# Altium schematic sheet schematic1.SchDoc (part 3 of 3)
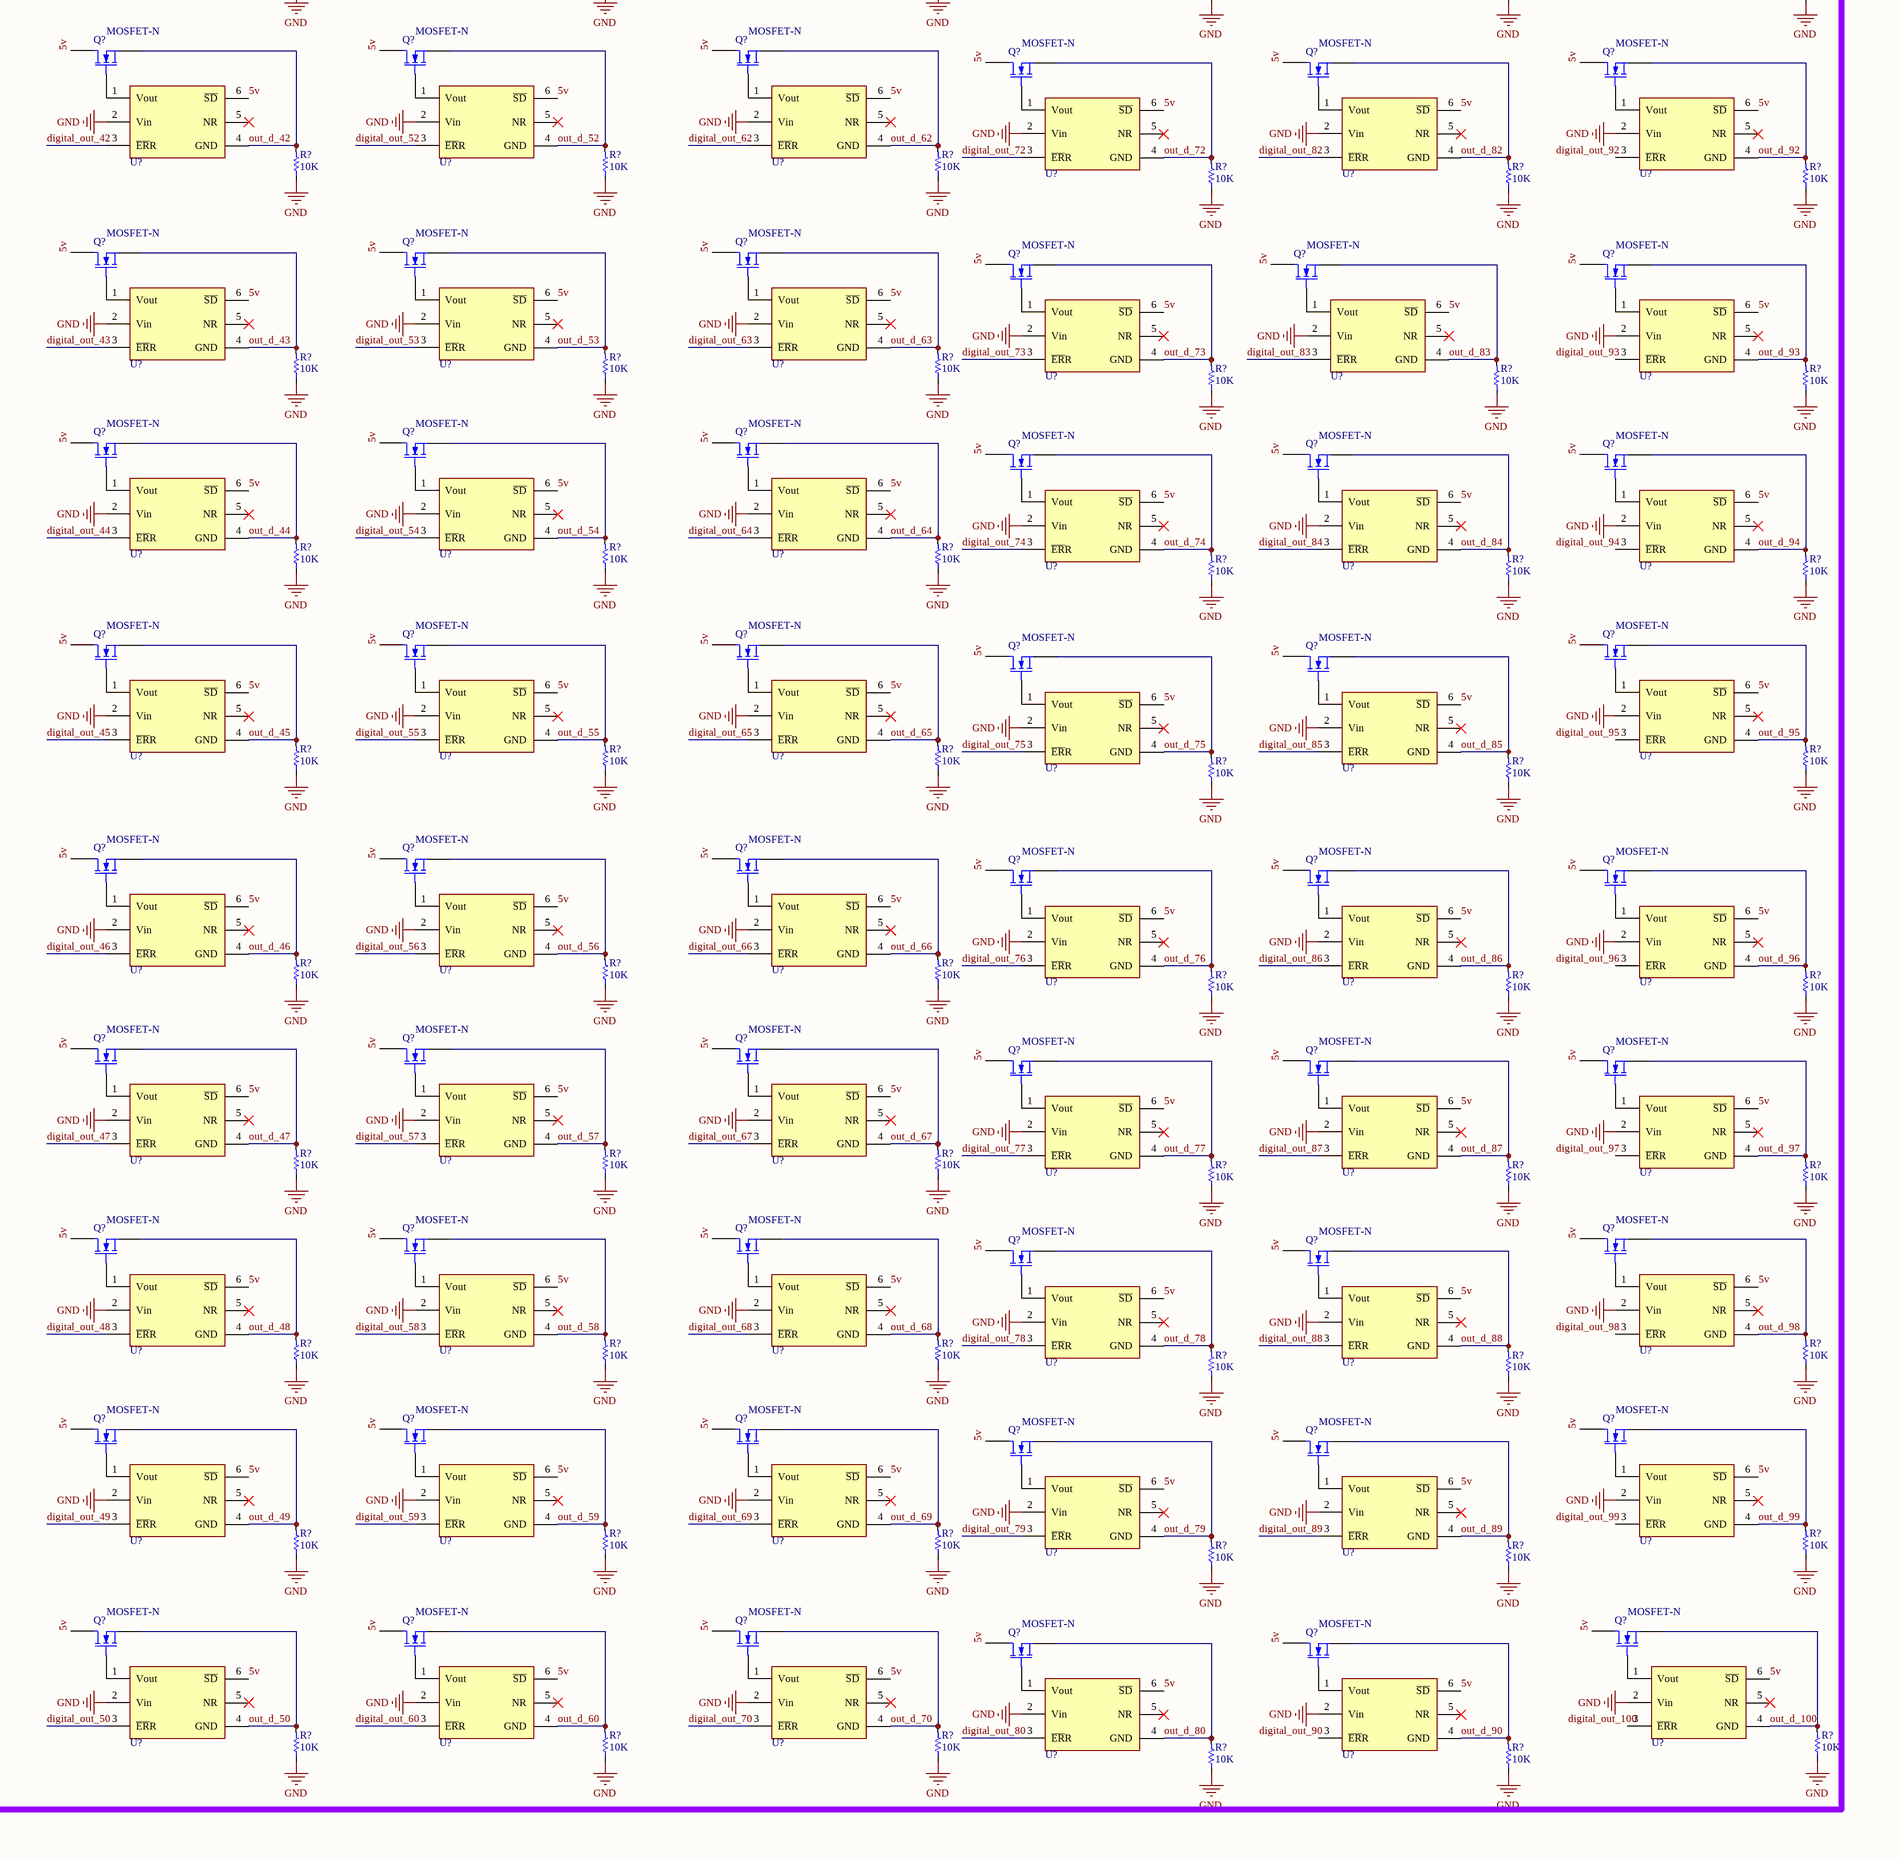
[diagram p9: schematic1.SchDoc, bottom column 4 of 4]

## Nets (continued)
NetQ?#24_2: Q?#24.2(G) U?#62.1(Vout)
NetQ?#25_2: Q?#25.2(G) U?#63.1(Vout)
NetQ?#26_2: Q?#26.2(G) U?#64.1(Vout)
NetQ?#27_2: Q?#27.2(G) U?#65.1(Vout)
NetQ?#28_2: Q?#28.2(G) U?#66.1(Vout)
NetQ?#29_2: Q?#29.2(G) U?#67.1(Vout)
NetQ?#30_2: Q?#30.2(G) U?#68.1(Vout)
NetQ?#31_2: Q?#31.2(G) U?#79.1(Vout)
NetQ?#32_2: Q?#32.2(G) U?#80.1(Vout)
NetQ?#33_2: Q?#33.2(G) U?#81.1(Vout)
NetQ?#34_2: Q?#34.2(G) U?#82.1(Vout)
NetQ?#35_2: Q?#35.2(G) U?#83.1(Vout)
NetQ?#36_2: Q?#36.2(G) U?#84.1(Vout)
NetQ?#37_2: Q?#37.2(G) U?#85.1(Vout)
NetQ?#38_2: Q?#38.2(G) U?#86.1(Vout)
NetQ?#39_2: Q?#39.2(G) U?#87.1(Vout)
NetQ?#40_2: Q?#40.2(G) U?#88.1(Vout)
NetQ?#41_2: Q?#41.2(G) U?#99.1(Vout)
NetQ?#42_2: Q?#42.2(G) U?#100.1(Vout)
NetQ?#43_2: Q?#43.2(G) U?#101.1(Vout)
NetQ?#44_2: Q?#44.2(G) U?#102.1(Vout)
NetQ?#45_2: Q?#45.2(G) U?#103.1(Vout)
NetQ?#46_2: Q?#46.2(G) U?#104.1(Vout)
NetQ?#47_2: Q?#47.2(G) U?#105.1(Vout)
NetQ?#48_2: Q?#48.2(G) U?#106.1(Vout)
NetQ?#49_2: Q?#49.2(G) U?#107.1(Vout)
NetQ?#50_2: Q?#50.2(G) U?#108.1(Vout)
NetQ?#51_2: Q?#51.2(G) U?#119.1(Vout)
NetQ?#52_2: Q?#52.2(G) U?#120.1(Vout)
NetQ?#53_2: Q?#53.2(G) U?#121.1(Vout)
NetQ?#54_2: Q?#54.2(G) U?#122.1(Vout)
NetQ?#55_2: Q?#55.2(G) U?#123.1(Vout)
NetQ?#56_2: Q?#56.2(G) U?#124.1(Vout)
NetQ?#57_2: Q?#57.2(G) U?#125.1(Vout)
NetQ?#58_2: Q?#58.2(G) U?#126.1(Vout)
NetQ?#59_2: Q?#59.2(G) U?#127.1(Vout)
NetQ?#60_2: Q?#60.2(G) U?#128.1(Vout)
NetQ?#61_2: Q?#61.2(G) U?#139.1(Vout)
NetQ?#62_2: Q?#62.2(G) U?#140.1(Vout)
NetQ?#63_2: Q?#63.2(G) U?#141.1(Vout)
NetQ?#64_2: Q?#64.2(G) U?#142.1(Vout)
NetQ?#65_2: Q?#65.2(G) U?#143.1(Vout)
NetQ?#66_2: Q?#66.2(G) U?#144.1(Vout)
NetQ?#67_2: Q?#67.2(G) U?#145.1(Vout)
NetQ?#68_2: Q?#68.2(G) U?#146.1(Vout)
NetQ?#69_2: Q?#69.2(G) U?#147.1(Vout)
NetQ?#70_2: Q?#70.2(G) U?#148.1(Vout)
NetQ?#71_2: Q?#71.2(G) U?#159.1(Vout)
NetQ?#72_2: Q?#72.2(G) U?#160.1(Vout)
NetQ?#73_2: Q?#73.2(G) U?#161.1(Vout)
NetQ?#74_2: Q?#74.2(G) U?#162.1(Vout)
NetQ?#75_2: Q?#75.2(G) U?#163.1(Vout)
NetQ?#76_2: Q?#76.2(G) U?#164.1(Vout)
NetQ?#77_2: Q?#77.2(G) U?#165.1(Vout)
NetQ?#78_2: Q?#78.2(G) U?#166.1(Vout)
NetQ?#79_2: Q?#79.2(G) U?#167.1(Vout)
NetQ?#80_2: Q?#80.2(G) U?#168.1(Vout)
NetQ?#81_2: Q?#81.2(G) U?#179.1(Vout)
NetQ?#82_2: Q?#82.2(G) U?#180.1(Vout)
NetQ?#83_2: Q?#83.2(G) U?#181.1(Vout)
NetQ?#84_2: Q?#84.2(G) U?#182.1(Vout)
NetQ?#85_2: Q?#85.2(G) U?#183.1(Vout)
NetQ?#86_2: Q?#86.2(G) U?#184.1(Vout)
NetQ?#87_2: Q?#87.2(G) U?#185.1(Vout)
NetQ?#88_2: Q?#88.2(G) U?#186.1(Vout)
NetQ?#89_2: Q?#89.2(G) U?#187.1(Vout)
NetQ?#90_2: Q?#90.2(G) U?#188.1(Vout)
NetQ?#91_2: Q?#91.2(G) U?#199.1(Vout)
NetQ?#92_2: Q?#92.2(G) U?#200.1(Vout)
NetQ?#93_2: Q?#93.2(G) U?#201.1(Vout)
NetQ?#94_2: Q?#94.2(G) U?#202.1(Vout)
NetQ?#95_2: Q?#95.2(G) U?#203.1(Vout)
NetQ?#96_2: Q?#96.2(G) U?#204.1(Vout)
NetQ?#97_2: Q?#97.2(G) U?#205.1(Vout)
NetQ?#98_2: Q?#98.2(G) U?#206.1(Vout)
NetQ?#99_2: Q?#99.2(G) U?#207.1(Vout)
NetQ?#100_2: Q?#100.2(G) U?#208.1(Vout)
NetR?#1_1: R?#1.1 R?#3.1 U3.63(PC6)
NetR?#2_1: R?#2.1 R?#4.1 U3.64(PC7)
NetR?#5_1: R?#5.1 R?#10.1 U1.63(PC6)
NetR?#6_1: R?#6.1 R?#12.1 U3.65(PC8(SDIO_D0))
NetR?#7_1: R?#7.1 R?#13.1 U3.67(PA8)
NetR?#8_1: R?#8.1 R?#14.1 U1.64(PC7)
NetR?#9_1: R?#9.1 R?#16.1 U3.66(PC9(SDIO_D1))
NetR?#11_1: R?#11.1 R?#18.1 U3.68(PA9(USART1_TX))
NetR?#15_1: R?#15.1 R?#22.1 U3.69(PA10(USART1_RX))
NetR?#17_1: R?#17.1 R?#24.1 U1.65(PC8(SDIO_D0))
NetR?#19_1: R?#19.1 R?#26.1 U1.67(PA8)
NetR?#20_1: R?#20.1 R?#27.1 U3.70(PA11)
NetR?#21_1: R?#21.1 R?#29.1 U1.66(PC9(SDIO_D1))
NetR?#23_1: R?#23.1 R?#30.1 U1.68(PA9(USART1_TX))
NetR?#25_1: R?#25.1 R?#31.1 U3.71(PA12)
NetR?#28_1: R?#28.1 R?#33.1 U1.69(PA10(USART1_RX))
NetR?#32_1: R?#32.1 R?#35.1 U1.70(PA11)
NetR?#34_1: R?#34.1 R?#36.1 U1.71(PA12)
NetR?#37_1: R?#37.1 R?#39.1 U3.36(PB1)
NetR?#38_1: R?#38.1 R?#40.1 U3.37(PB2/BOOT1)
NetR?#41_1: R?#41.1 R?#43.1 U1.36(PB1)
NetR?#42_1: R?#42.1 R?#44.1 U1.37(PB2/BOOT1)
NetR?#45_1: R?#45.1 R?#47.2 U3.55(PD8(USART3_TX))
NetR?#46_1: R?#46.1 R?#53.1 U3.57(PD10)
NetR?#48_1: R?#48.1 R?#54.1 U3.47(PB10(I2C2_SCL))
NetR?#49_1: R?#49.1 R?#51.2 U3.56(PD9(USART3_RX))
NetR?#50_1: R?#50.1 R?#58.1 U3.58(PD11)
NetR?#52_1: R?#52.1 R?#61.1 U3.48(PB11(I2C2_SDA))
NetR?#55_1: R?#55.1 R?#66.1 U3.59(PD12)
NetR?#56_1: R?#56.1 R?#60.2 U1.55(PD8(USART3_TX))
NetR?#57_1: R?#57.1 R?#69.1 U3.51(PB12(SPI2_NSS))
NetR?#59_1: R?#59.1 R?#72.1 U1.57(PD10)
NetR?#62_1: R?#62.1 R?#74.1 U3.60(PD13)
NetR?#63_1: R?#63.1 R?#75.1 U1.47(PB10(I2C2_SCL))
NetR?#64_1: R?#64.1 R?#68.2 U1.56(PD9(USART3_RX))
NetR?#65_1: R?#65.1 R?#77.1 U3.52(PB13(SPI2_SCK))
NetR?#67_1: R?#67.1 R?#80.1 U1.58(PD11)
NetR?#70_1: R?#70.1 R?#82.1 U3.61(PD14)
NetR?#71_1: R?#71.1 R?#83.1 U1.48(PB11(I2C2_SDA))
NetR?#73_1: R?#73.1 R?#85.1 U3.53(PB14(SPI2_MISO))
NetR?#76_1: R?#76.1 R?#87.1 U1.59(PD12)
NetR?#78_1: R?#78.1 R?#88.1 U3.62(PD15)
NetR?#79_1: R?#79.1 R?#89.1 U1.51(PB12(SPI2_NSS))
NetR?#81_1: R?#81.1 R?#91.1 U3.54(PB15(SPI2_MOSI))
NetR?#84_1: R?#84.1 R?#93.1 U1.60(PD13)
NetR?#86_1: R?#86.1 R?#94.1 U1.52(PB13(SPI2_SCK))
NetR?#90_1: R?#90.1 R?#97.1 U1.61(PD14)
NetR?#92_1: R?#92.1 R?#98.1 U1.53(PB14(SPI2_MISO))
NetR?#95_1: R?#95.1 R?#99.1 U1.62(PD15)
NetR?#96_1: R?#96.1 R?#100.1 U1.54(PB15(SPI2_MOSI))
NetR?#101_2: R?#101.2 U3.94(BOOT0)
NetR?#102_2: R?#102.2 R?#103.1 U3.38(PE7)
NetR?#104_2: R?#104.2 U1.94(BOOT0)
NetR?#105_2: R?#105.2 R?#106.1 U1.38(PE7)
NetR?#107_1: R?#107.1 R?#109.2 U3.39(PE8)
NetR?#108_1: R?#108.1 R?#113.1 U3.41(PE10)
NetR?#110_1: R?#110.1 R?#112.2 U3.40(PE9)
NetR?#111_1: R?#111.1 R?#116.1 U3.42(PE11)
NetR?#114_1: R?#114.1 R?#121.1 U3.43(PE12)
NetR?#115_1: R?#115.1 R?#118.2 U1.39(PE8)
NetR?#117_1: R?#117.1 R?#125.1 U1.41(PE10)
NetR?#119_1: R?#119.1 R?#126.1 U3.44(PE13)
NetR?#120_1: R?#120.1 R?#123.2 U1.40(PE9)
NetR?#122_1: R?#122.1 R?#129.1 U1.42(PE11)
NetR?#124_1: R?#124.1 R?#130.1 U3.45(PE14)
NetR?#127_1: R?#127.1 R?#133.1 U1.43(PE12)
NetR?#128_1: R?#128.1 R?#134.1 U3.46(PE15)
NetR?#131_1: R?#131.1 R?#136.1 U1.44(PE13)
NetR?#135_1: R?#135.1 R?#138.1 U1.45(PE14)
NetR?#137_1: R?#137.1 R?#139.1 U1.46(PE15)
NetR?#140_1: R?#140.1 U?#5.E4(PS_MIO4_500)
NetR?#143_1: R?#143.1 R?#146.1 U2.63(PC6)
NetR?#144_1: R?#144.1 R?#147.1 U2.64(PC7)
NetR?#148_1: R?#148.1 R?#152.1 U2.65(PC8(SDIO_D0))
NetR?#149_1: R?#149.1 R?#153.1 U2.67(PA8)
NetR?#150_1: R?#150.1 R?#155.1 U2.66(PC9(SDIO_D1))
NetR?#151_1: R?#151.1 R?#156.1 U2.68(PA9(USART1_TX))
NetR?#154_1: R?#154.1 R?#159.1 U2.69(PA10(USART1_RX))
NetR?#158_1: R?#158.1 R?#162.1 U2.70(PA11)
NetR?#161_1: R?#161.1 R?#163.1 U2.71(PA12)
NetR?#168_1: R?#168.1 R?#171.1 U2.36(PB1)
NetR?#170_1: R?#170.1 R?#173.1 U2.37(PB2/BOOT1)
NetR?#172_2: R?#172.2 U?#6.10(LED[0])
NetR?#174_2: R?#174.2 U?#6.9(LED[1])
NetR?#175_1: R?#175.1 U?#7.T14(INIT_B_0)
NetR?#179_1: R?#179.1 R?#181.2 U2.55(PD8(USART3_TX))
NetR?#180_1: R?#180.1 R?#187.1 U2.57(PD10)
NetR?#182_1: R?#182.1 R?#188.1 U2.47(PB10(I2C2_SCL))
NetR?#183_1: R?#183.1 R?#185.2 U2.56(PD9(USART3_RX))
NetR?#184_1: R?#184.1 R?#191.1 U2.58(PD11)
NetR?#186_1: R?#186.1 R?#192.1 U2.48(PB11(I2C2_SDA))
NetR?#189_1: R?#189.1 R?#195.1 U2.59(PD12)
NetR?#190_1: R?#190.1 R?#196.1 U2.51(PB12(SPI2_NSS))
NetR?#193_1: R?#193.1 R?#201.1 U2.60(PD13)
NetR?#194_1: R?#194.1 R?#202.1 U2.52(PB13(SPI2_SCK))
NetR?#197_1: R?#197.1 R?#205.1 U2.61(PD14)
NetR?#199_1: R?#199.1 U?#7.T13(CFGBVS_0)
NetR?#200_1: R?#200.1 R?#206.1 U2.53(PB14(SPI2_MISO))
NetR?#203_1: R?#203.1 R?#207.1 U2.62(PD15)
NetR?#204_1: R?#204.1 R?#208.1 U2.54(PB15(SPI2_MOSI))
NetR?#209_2: R?#209.2 U?#6.25(RSET)
NetR?#210_2: R?#210.2 U2.94(BOOT0)
NetR?#211_2: R?#211.2 R?#212.1 U2.38(PE7)
NetR?#213_1: R?#213.1 R?#215.2 U2.39(PE8)
NetR?#214_1: R?#214.1 R?#220.1 U2.41(PE10)
NetR?#216_1: R?#216.1 R?#218.2 U2.40(PE9)
NetR?#217_1: R?#217.1 R?#222.1 U2.42(PE11)
NetR?#219_1: R?#219.1 Y?#4.3(OUTPUT)
NetR?#221_1: R?#221.1 R?#224.1 U2.43(PE12)
NetR?#223_1: R?#223.1 R?#227.1 U2.44(PE13)
NetR?#225_1: R?#225.1 R?#229.1 U2.45(PE14)
NetR?#228_1: R?#228.1 R?#231.1 U2.46(PE15)
NetR?#233_2: R?#233.2 U6.A4(DACVDD_2)
NetR?#234_2: R?#234.2 U4.A4(DACVDD_2)
NetR?#235_2: R?#235.2 U5.A4(DACVDD_2)
NetR?#236_2: R?#236.2 U6.M8(ADCVDD)
NetR?#237_2: R?#237.2 U4.M8(ADCVDD)
NetR?#238_2: R?#238.2 U5.M8(ADCVDD)
NetR?#249_2: R?#249.2 U6.B8(DACVDD)
NetR?#250_2: R?#250.2 U4.B8(DACVDD)
NetR?#251_2: R?#251.2 U5.B8(DACVDD)
NetR?#262_2: R?#262.2 U11.12(R1OUT)
NetR?#263_2: R?#263.2 U11.9(R2OUT)
NetR?#279_2: R?#279.2 U12.12(R1OUT)
NetR?#285_2: R?#285.2 U12.9(R2OUT)
NetR?#286_2: R?#286.2 U7.A4(DACVDD_2)
NetR?#287_2: R?#287.2 U8.A4(DACVDD_2)
NetR?#288_2: R?#288.2 U9.A4(DACVDD_2)
NetR?#289_2: R?#289.2 U10.A4(DACVDD_2)
NetR?#300_2: R?#300.2 U7.M8(ADCVDD)
NetR?#301_2: R?#301.2 U8.M8(ADCVDD)
NetR?#302_2: R?#302.2 U9.M8(ADCVDD)
NetR?#303_2: R?#303.2 U10.M8(ADCVDD)
NetR?#304_2: R?#304.2 U7.B8(DACVDD)
NetR?#305_2: R?#305.2 U8.B8(DACVDD)
NetR?#306_2: R?#306.2 U9.B8(DACVDD)
NetR?#307_2: R?#307.2 U10.B8(DACVDD)
NetR?#308_2: R?#308.2 U13.12(R1OUT)
NetR?#309_2: R?#309.2 U13.9(R2OUT)
NetR?#330_2: R?#330.2 U14.12(R1OUT)
NetR?#331_2: R?#331.2 U14.9(R2OUT)
NetR?#342_2: R?#342.2 U15.12(R1OUT)
NetR?#343_2: R?#343.2 U15.9(R2OUT)

Not connected (* = marked no-connect by the designer): bank33 AA13(IO_L23N_T3_33) AA14(IO_L22N_T3_33) AA16(IO_L18P_T2_33) AA17(IO_L17P_T2_33) AA18(IO_L12N_T1_MRCC_33) AA19(IO_L11N_T1_SRCC_33) AA21(IO_L8P_T1_33) AA22(IO_L7P_T1_33) AB14(IO_L24P_T3_33) AB15(IO_L24N_T3_33) AB16(IO_L18N_T2_33) AB17(IO_L17N_T2_33) AB19(IO_L10P_T1_33) AB20(IO_L10N_T1_33) AB21(IO_L8N_T1_33) AB22(IO_L7N_T1_33) U14(IO_25_33) U15(IO_L15P_T2_DQS_33) U16(IO_L15N_T2_DQS_33) U17(IO_L16P_T2_33) V13(IO_L20P_T3_33) V14(IO_L19P_T3_33) V15(IO_L19N_T3_VREF_33) V17(IO_L16N_T2_33) V18(IO_L6P_T0_33) V19(IO_L6N_T0_VREF_33) V20(IO_L5N_T0_33) W13(IO_L20N_T3_33) W15(IO_L21P_T3_DQS_33) W16(IO_L14P_T2_SRCC_33) W17(IO_L13P_T2_MRCC_33) W18(IO_L13N_T2_MRCC_33) Y13(IO_L23P_T3_33) Y14(IO_L22P_T3_33) Y15(IO_L21N_T3_DQS_33) Y16(IO_L14N_T2_SRCC_33) Y18(IO_L12P_T1_MRCC_33) Y19(IO_L11P_T1_SRCC_33) Y20(IO_L9P_T1_DQS_33) Y21(IO_L9N_T1_DQS_33); bank35 A16(IO_L9P_T1_DQS_AD3P_35) A17(IO_L9N_T1_DQS_AD3N_35) A18(IO_L10P_T1_AD11P_35) A19(IO_L10N_T1_AD11N_35) A21(IO_L15P_T2_DQS_AD12P_35) A22(IO_L15N_T2_DQS_AD12N_35) B15(IO_L7N_T1_AD2N_35) B16(IO_L8P_T1_AD10P_35) B17(IO_L8N_T1_AD10N_35) B19(IO_L13P_T2_MRCC_35) B20(IO_L13N_T2_MRCC_35) B21(IO_L18P_T2_AD13P_35) B22(IO_L18N_T2_AD13N_35) C15(IO_L7P_T1_AD2P_35) C17(IO_L11P_T1_SRCC_35) C18(IO_L11N_T1_SRCC_35) C19(IO_L12N_T1_MRCC_35) C20(IO_L14N_T2_AD4N_SRCC_35) C22(IO_L16N_T2_35) D15(IO_L3N_T0_DQS_AD1N_35) D16(IO_L2P_T0_AD8P_35) D17(IO_L2N_T0_AD8N_35) D18(IO_L12P_T1_MRCC_35) D20(IO_L14P_T2_AD4P_SRCC_35) D21(IO_L17N_T2_AD5N_35) D22(IO_L16P_T2_35) E15(IO_L3P_T0_DQS_AD1P_35) E16(IO_L1N_T0_AD0N_35) E18(IO_L5N_T0_AD9N_35) E19(IO_L21P_T3_DQS_AD14P_35) E20(IO_L21N_T3_DQS_AD14N_35) E21(IO_L17P_T2_AD5P_35) F16(IO_L1P_T0_AD0P_35) F17(IO_L6N_T0_VREF_35) F18(IO_L5P_T0_AD9P_35) F19(IO_L20N_T3_AD6N_35) F21(IO_L23P_T3_35) F22(IO_L23N_T3_35) G15(IO_L4P_T0_35) G16(IO_L4N_T0_35) G17(IO_L6P_T0_35) G19(IO_L20P_T3_AD6P_35) G20(IO_L22P_T3_AD7P_35) G21(IO_L22N_T3_AD7N_35) G22(IO_L24N_T3_AD15N_35) H17(IO_0_35) H18(IO_25_35) H19(IO_L19P_T3_35) H20(IO_L19N_T3_VREF_35) H22(IO_L24P_T3_AD15P_35); bank_34 H15(IO_0_34) J15(IO_L1P_T0_34) J16(IO_L2P_T0_34) J17(IO_L2N_T0_34) J18(IO_L7P_T1_34) J20(IO_L9P_T1_DQS_34) J21(IO_L8P_T1_34) J22(IO_L8N_T1_34) K15(IO_L1N_T0_34) K16(IO_L3P_T0_DQS_PUDC_B_34) K18(IO_L7N_T1_34) K19(IO_L11P_T1_SRCC_34) K20(IO_L11N_T1_SRCC_34) K21(IO_L9N_T1_DQS_34) L16(IO_L3N_T0_DQS_34) L17(IO_L4P_T0_34) L18(IO_L12P_T1_MRCC_34) L19(IO_L12N_T1_MRCC_34) L21(IO_L10P_T1_34) L22(IO_L10N_T1_34) M15(IO_L6P_T0_34) M16(IO_L6N_T0_VREF_34) M17(IO_L4N_T0_34) M19(IO_L13P_T2_MRCC_34) M20(IO_L13N_T2_MRCC_34) M21(IO_L15P_T2_DQS_34) M22(IO_L15N_T2_DQS_34) N15(IO_L19P_T3_34) N17(IO_L5P_T0_34) N18(IO_L5N_T0_34) N19(IO_L14P_T2_SRCC_34) N20(IO_L14N_T2_SRCC_34) N22(IO_L16P_T2_34) P15(IO_L19N_T3_VREF_34) P16(IO_L24P_T3_34) P17(IO_L20P_T3_34) P18(IO_L20N_T3_34) P20(IO_L18P_T2_34) P21(IO_L18N_T2_34) P22(IO_L16N_T2_34) R15(IO_25_34) R16(IO_L24N_T3_34) R18(IO_L23P_T3_34) R19(IO_L22P_T3_34) R20(IO_L17P_T2_34) R21(IO_L17N_T2_34) T16(IO_L21P_T3_DQS_34) T17(IO_L21N_T3_DQS_34) T18(IO_L23N_T3_34) T19(IO_L22N_T3_34); J1 1* 4* 6* 7* 8* 9*; J2 1* 4* 6* 7* 8* 9*; J?#1 9(VCC)*; J?#6 12; J?#9 1* 4* 6* 7* 8* 9*; J?#10 1* 4* 6* 7* 8* 9*; J?#11 1* 4* 6* 7* 8* 9*; J?#12 1* 4* 6* 7* 8* 9*; J?#13 1* 4* 6* 7* 8* 9*; J?#14 1* 4* 6* 7* 8* 9*; J?#15 1* 4* 6* 7* 8* 9*; J?#16 1* 4* 6* 7* 8* 9*; p?#9 8 24; U1 6(VBAT) 20(VREF-) 21(VREF+) 24(PA1) 25(PA2(usart2_TX)) 26(PA3(usart2_RX)) 33(PC4(ADC12_IN14)) 34(PC5(ADC12_IN15)) 35(PB0) 73(NC); U2 6(VBAT) 20(VREF-) 21(VREF+) 24(PA1) 25(PA2(usart2_TX)) 26(PA3(usart2_RX)) 33(PC4(ADC12_IN14)) 34(PC5(ADC12_IN15)) 35(PB0) 73(NC); U3 6(VBAT) 18(PC3(ADC123_IN13)) 20(VREF-) 21(VREF+) 23(PA0-WKUP) 24(PA1) 25(PA2(usart2_TX)) 26(PA3(usart2_RX)) 33(PC4(ADC12_IN14)) 34(PC5(ADC12_IN15)) 35(PB0) 73(NC); U4 A5(DSYNC1*)* A8(LDAC*)* B1(OUT2)* B6(CLR*)* B7(DSYNC2*)* C1(IN2+)* C12(OUT7)* D1(IN2-)* D12(IN7-)* E1(IN3+)* E12(IN7+)* F1(IN3-)* F2(VREFIN1/_VREFOUT1)* F12(IN6+)* G1(OUT3)* G11(VREFIN2/_VREFOUT2)* G12(IN6-)* H1(OUT1)* H2(V1-) H12(V2-) J1(IN1-)* J11(VREFA)* J12(OUT6)* K1(IN1+)* K12(OUT5)* L1(OUT0)* L6(VDRIVE) L8(ADIN)* L9(V2+) L12(IN5-)* M1(IN0-)* M2(IN0+)* M3(V1+) M7(ASYNC*)* M9(OUT4)* M10(IN4-)* M11(IN4+)* M12(IN5+)*; U5 A5(DSYNC1*)* A8(LDAC*)* B1(OUT2)* B6(CLR*)* B7(DSYNC2*)* C1(IN2+)* C12(OUT7)* D1(IN2-)* D12(IN7-)* E1(IN3+)* E12(IN7+)* F1(IN3-)* F2(VREFIN1/_VREFOUT1)* F12(IN6+)* G1(OUT3)* G11(VREFIN2/_VREFOUT2)* G12(IN6-)* H1(OUT1)* H2(V1-) H12(V2-) J1(IN1-)* J11(VREFA)* J12(OUT6)* K1(IN1+)* K12(OUT5)* L1(OUT0)* L6(VDRIVE) L8(ADIN)* L9(V2+) L12(IN5-)* M1(IN0-)* M2(IN0+)* M3(V1+) M7(ASYNC*)* M9(OUT4)* M10(IN4-)* M11(IN4+)* M12(IN5+)*; U6 A5(DSYNC1*)* A8(LDAC*)* B1(OUT2)* B6(CLR*)* B7(DSYNC2*)* C1(IN2+)* C12(OUT7)* D1(IN2-)* D12(IN7-)* E1(IN3+)* E12(IN7+)* F1(IN3-)* F2(VREFIN1/_VREFOUT1)* F12(IN6+)* G1(OUT3)* G11(VREFIN2/_VREFOUT2)* G12(IN6-)* H1(OUT1)* H2(V1-) H12(V2-) J1(IN1-)* J11(VREFA)* J12(OUT6)* K1(IN1+)* K12(OUT5)* L1(OUT0)* L6(VDRIVE) L8(ADIN)* L9(V2+) L12(IN5-)* M1(IN0-)* M2(IN0+)* M3(V1+) M7(ASYNC*)* M9(OUT4)* M10(IN4-)* M11(IN4+)* M12(IN5+)*; U7 A5(DSYNC1*)* A8(LDAC*)* B1(OUT2)* B6(CLR*)* B7(DSYNC2*)* C1(IN2+)* C12(OUT7)* D1(IN2-)* D12(IN7-)* E1(IN3+)* E12(IN7+)* F1(IN3-)* F2(VREFIN1/_VREFOUT1)* F12(IN6+)* G1(OUT3)* G11(VREFIN2/_VREFOUT2)* G12(IN6-)* H1(OUT1)* H2(V1-) H12(V2-) J1(IN1-)* J11(VREFA)* J12(OUT6)* K1(IN1+)* K12(OUT5)* L1(OUT0)* L6(VDRIVE) L8(ADIN)* L9(V2+) L12(IN5-)* M1(IN0-)* M2(IN0+)* M3(V1+) M7(ASYNC*)* M9(OUT4)* M10(IN4-)* M11(IN4+)* M12(IN5+)*; U8 A5(DSYNC1*)* A8(LDAC*)* B1(OUT2)* B6(CLR*)* B7(DSYNC2*)* C1(IN2+)* C12(OUT7)* D1(IN2-)* D12(IN7-)* E1(IN3+)* E12(IN7+)* F1(IN3-)* F2(VREFIN1/_VREFOUT1)* F12(IN6+)* G1(OUT3)* G11(VREFIN2/_VREFOUT2)* G12(IN6-)* H1(OUT1)* H2(V1-) H12(V2-) J1(IN1-)* J11(VREFA)* J12(OUT6)* K1(IN1+)* K12(OUT5)* L1(OUT0)* L6(VDRIVE) L8(ADIN)* L9(V2+) L12(IN5-)* M1(IN0-)* M2(IN0+)* M3(V1+) M7(ASYNC*)* M9(OUT4)* M10(IN4-)* M11(IN4+)* M12(IN5+)*; U9 A5(DSYNC1*)* A8(LDAC*)* B1(OUT2)* B6(CLR*)* B7(DSYNC2*)* C1(IN2+)* C12(OUT7)* D1(IN2-)* D12(IN7-)* E1(IN3+)* E12(IN7+)* F1(IN3-)* F2(VREFIN1/_VREFOUT1)* F12(IN6+)* G1(OUT3)* G11(VREFIN2/_VREFOUT2)* G12(IN6-)* H1(OUT1)* H2(V1-) H12(V2-) J1(IN1-)* J11(VREFA)* J12(OUT6)* K1(IN1+)* K12(OUT5)* L1(OUT0)* L6(VDRIVE) L8(ADIN)* L9(V2+) L12(IN5-)* M1(IN0-)* M2(IN0+)* M3(V1+) M7(ASYNC*)* M9(OUT4)* M10(IN4-)* M11(IN4+)* M12(IN5+)*; U10 A2(VOUT7)* A3(VOUT5)* A5(DSYNC1*)* A8(LDAC*)* A10(VOUT8)* A11(VOUT10)* A12(VOUT14)* B1(OUT2)* B2(VIN8)* B3(VIN9)* B6(CLR*)* B7(DSYNC2*)* B10(VOUT12)* B11(VIN10)* B12(VIN12)* C1(IN2+)* C11(VOUT9)* C12(OUT7)* D1(IN2-)* D2(VOUT4)* D11(VOUT11)* D12(IN7-)* E1(IN3+)* E2(VOUT6)* E11(VOUT13)* E12(IN7+)* F1(IN3-)* F2(VREFIN1/_VREFOUT1)* F11(VOUT15)* F12(IN6+)* G1(OUT3)* G2(VIN5)* G11(VREFIN2/_VREFOUT2)* G12(IN6-)* H1(OUT1)* H2(V1-) H11(VIN15)* H12(V2-) J1(IN1-)* J2(VIN7)* J11(VREFA)* J12(OUT6)* K1(IN1+)* K2(VIN6)* K11(VIN14)* K12(OUT5)* L1(OUT0)* L2(VIN4)* L6(VDRIVE) L8(ADIN)* L9(V2+) L10(VIN13)* L11(VIN11) L12(IN5-)* M1(IN0-)* M2(IN0+)* M3(V1+) M7(ASYNC*)* M9(OUT4)* M10(IN4-)* M11(IN4+)* M12(IN5+)*; U?#1 AA1(PS_DDR_DQ26_502)* AA2(PS_DDR_DM3_502)* AA3(PS_DDR_DQ24_502)* B1(PS_DDR_DM0_502)* B2(PS_DDR_DQ2_502)* C2(PS_DDR_DQS_P0_502)* C3(PS_DDR_DQ1_502)* D1(PS_DDR_DQ0_502)* D2(PS_DDR_DQS_N0_502)* D3(PS_DDR_DQ3_502)* E1(PS_DDR_DQ5_502)* E3(PS_DDR_DQ4_502)* F1(PS_DDR_DQ7_502)* F2(PS_DDR_DQ6_502)* F3(PS_DDR_DRST_B_502)* F4(PS_DDR_A13_502)* G1(PS_DDR_DQ9_502)* G2(PS_DDR_DQ8_502)* G4(PS_DDR_A14_502)* G5(PS_DDR_A11_502)* H2(PS_DDR_DQS_P1_502)* H3(PS_DDR_DM1_502)* H4(PS_DDR_A12_502)* H5(PS_DDR_A9_502)* H7(PS_DDR_VREF0_502)* J1(PS_DDR_DQ14_502)* J2(PS_DDR_DQS_N1_502)* J3(PS_DDR_A10_502)* J5(PS_DDR_A8_502)* J6(PS_DDR_A7_502)* J7(PS_DDR_A6_502)* K1(PS_DDR_DQ13_502)* K3(PS_DDR_DQ15_502)* K4(PS_DDR_A2_502)* K5(PS_DDR_A5_502)* K6(PS_DDR_A4_502)* L1(PS_DDR_DQ10_502)* L2(PS_DDR_DQ11_502)* L3(PS_DDR_DQ12_502)* L4(PS_DDR_A3_502)* L6(PS_DDR_BA1_502)* L7(PS_DDR_BA0_502)* M1(PS_DDR_DQ16_502)* M2(PS_DDR_DQ22_502)* M4(PS_DDR_A0_502)* M5(PS_DDR_A1_502)* M6(PS_DDR_BA2_502)* M7(PS_DDR_VRN_502)* N2(PS_DDR_DQS_P2_502)* N3(PS_DDR_DQ18_502)* N4(PS_DDR_CKP_502)* N5(PS_DDR_CKN_502)* N7(PS_DDR_VRP_502)* P1(PS_DDR_DM2_502)* P2(PS_DDR_DQS_N2_502)* P3(PS_DDR_CAS_B_502)* P5(PS_DDR_ODT_502)* P6(PS_DDR_CS_B_502)* P7(PS_DDR_VREF1_502)* R1(PS_DDR_DQ23_502)* R3(PS_DDR_DQ20_502)* R4(PS_DDR_WE_B_502)* R5(PS_DDR_RAS_B_502)* T1(PS_DDR_DQ19_502)* T2(PS_DDR_DQ21_502)* T3(PS_DDR_DQ17_502)* U1(PS_DDR_DQ25_502)* U2(PS_DDR_DQ27_502)* V2(PS_DDR_DQS_P3_502)* V3(PS_DDR_CKE_502)* W1(PS_DDR_DQ28_502)* W2(PS_DDR_DQS_N3_502)* W3(PS_DDR_DQ30_502)* Y1(PS_DDR_DQ31_502)* Y3(PS_DDR_DQ29_502)*; U?#3 G10(RSVDGND) K12(GNDADC_0); U?#5 A9(PS_MIO36_501) A11(PS_MIO30_501) A12(PS_MIO28_501) A13(PS_MIO26_501) A14(PS_MIO22_501) B5(PS_POR_B_500)* B7(PS_MIO24_501) B9(PS_MIO45_501) B10(PS_MIO47_501) B11(PS_MIO43_501) B12(PS_MIO34_501) B14(PS_MIO37_501) C7(PS_MIO32_501) C8(PS_MIO41_501) C10(PS_MIO51_501) C12(PS_MIO53_501) C13(PS_MIO39_501) C14(PS_MIO49_501) D7(PS_MIO27_501) D8(PS_MIO42_501) D10(PS_MIO52_501) D11(PS_MIO48_501) D12(PS_MIO46_501) D13(PS_MIO50_501) E8(PS_MIO29_501) E11(PS_MIO23_501) E13(PS_MIO44_501) E14(PS_MIO40_501) F9(PS_MIO31_501) F11(PS_MIO21_501) F12(PS_MIO25_501) F13(PS_MIO38_501) F14(PS_MIO35_501) G13(PS_MIO33_501); U?#6 6(CLK125)* 8(LED[2]/INTN)* 26(HSDACN)* 27(HSDACP)* 31(REG_IN)* 32(REGCAP1)* 33(AVDD18_OUT)* 34(DVDD_OUT)* 35(REGCAP2)* 49(EPAD)*; U?#9 5(NR)*; U?#10 1(Vout) 5(NR)*; U?#11 5(NR)*; U?#12 5(NR)*; U?#13 5(NR)*; U?#14 5(NR)*; U?#15 5(NR)*; U?#16 5(NR)*; U?#17 5(NR)*; U?#18 5(NR)*; U?#19 5(NR)*; U?#20 5(NR)*; U?#21 5(NR)*; U?#22 5(NR)*; U?#23 3(~{ER}R) 5(NR)*; U?#24 5(NR)*; U?#25 5(NR)*; U?#26 5(NR)*; U?#27 5(NR)*; U?#28 5(NR)*; U?#29 5(NR)*; U?#30 5(NR)*; U?#31 5(NR)*; U?#32 5(NR)*; U?#33 5(NR)*; U?#34 5(NR)*; U?#35 5(NR)*; U?#36 5(NR)*; U?#37 5(NR)*; U?#38 5(NR)*; U?#39 5(NR)*; U?#40 5(NR)*; U?#41 5(NR)*; U?#42 5(NR)*; U?#43 3(~{ER}R) 5(NR)*; U?#44 5(NR)*; U?#45 5(NR)*; U?#46 5(NR)*; U?#47 5(NR)*; U?#48 5(NR)*; U?#49 5(NR)*; U?#50 5(NR)*; U?#51 5(NR)*; U?#52 5(NR)*; U?#53 5(NR)*; U?#54 5(NR)*; U?#55 5(NR)*; U?#56 5(NR)*; U?#57 5(NR)*; U?#58 5(NR)*; U?#59 5(NR)*; U?#60 5(NR)*; U?#61 3(~{ER}R) 5(NR)*; U?#62 5(NR)*; U?#63 5(NR)*; U?#64 5(NR)*; U?#65 5(NR)*; U?#66 5(NR)*; U?#67 5(NR)*; U?#68 3(~{ER}R) 5(NR)*; U?#69 5(NR)*; U?#70 5(NR)*; U?#71 5(NR)*; U?#72 5(NR)*; U?#73 5(NR)*; U?#74 5(NR)*; U?#75 5(NR)*; U?#76 5(NR)*; U?#77 5(NR)*; U?#78 5(NR)*; U?#79 5(NR)*; U?#80 5(NR)*; U?#81 5(NR)*; U?#82 5(NR)*; U?#83 5(NR)*; U?#84 5(NR)*; U?#85 5(NR)*; U?#86 5(NR)*; U?#87 5(NR)*; U?#88 3(~{ER}R) 5(NR)*; U?#89 5(NR)*; U?#90 5(NR)*; U?#91 5(NR)*; U?#92 5(NR)*; U?#93 5(NR)*; U?#94 5(NR)*; U?#95 5(NR)*; U?#96 1(Vout) 5(NR)*; U?#97 5(NR)*; U?#98 5(NR)*; U?#99 5(NR)*; U?#100 5(NR)*; U?#101 5(NR)*; U?#102 5(NR)*; U?#103 5(NR)*; U?#104 5(NR)*; U?#105 3(~{ER}R) 5(NR)*; U?#106 5(NR)*; U?#107 5(NR)*; U?#108 5(NR)*; U?#109 5(NR)*; U?#110 5(NR)*; U?#111 5(NR)*; U?#112 5(NR)*; U?#113 5(NR)*; U?#114 5(NR)*; U?#115 5(NR)*; U?#116 5(NR)*; U?#117 5(NR)*; U?#118 5(NR)*; U?#119 5(NR)*; U?#120 5(NR)*; U?#121 5(NR)*; U?#122 5(NR)*; U?#123 5(NR)*; U?#124 5(NR)*; U?#125 5(NR)*; U?#126 5(NR)*; U?#127 5(NR)*; U?#128 3(~{ER}R) 5(NR)*; U?#129 5(NR)*; U?#130 5(NR)*; U?#131 5(NR)*; U?#132 5(NR)*; U?#133 5(NR)*; U?#134 5(NR)*; U?#135 5(NR)*; U?#136 5(NR)*; U?#137 5(NR)*; U?#138 5(NR)*; U?#139 5(NR)*; U?#140 5(NR)*; U?#141 5(NR)*; U?#142 5(NR)*; U?#143 5(NR)*; U?#144 5(NR)*; U?#145 5(NR)*; U?#146 5(NR)*; U?#147 5(NR)*; U?#148 3(~{ER}R) 5(NR)*; U?#149 5(NR)*; U?#150 5(NR)*; U?#151 5(NR)*; U?#152 5(NR)*; U?#153 5(NR)*; U?#154 5(NR)*; U?#155 5(NR)*; U?#156 5(NR)*; U?#157 5(NR)*; U?#158 5(NR)*; U?#159 5(NR)*; U?#160 5(NR)*; U?#161 5(NR)*; U?#162 5(NR)*; U?#163 5(NR)*; U?#164 5(NR)*; U?#165 5(NR)*; U?#166 3(~{ER}R) 5(NR)*; U?#167 5(NR)*; U?#168 5(NR)*; U?#169 5(NR)*; U?#170 3(~{ER}R) 5(NR)*; U?#171 5(NR)*; U?#172 5(NR)*; U?#173 5(NR)*; U?#174 5(NR)*; U?#175 3(~{ER}R) 5(NR)*; U?#176 5(NR)*; U?#177 5(NR)*; U?#178 5(NR)*; U?#179 5(NR)*; U?#180 5(NR)*; U?#181 5(NR)*; U?#182 5(NR)*; U?#183 5(NR)*; U?#184 5(NR)*; U?#185 5(NR)*; U?#186 3(~{ER}R) 5(NR)*; U?#187 5(NR)*; U?#188 5(NR)*; U?#189 5(NR)*; U?#190 3(~{ER}R) 5(NR)*; U?#191 5(NR)*; U?#192 5(NR)*; U?#193 5(NR)*; U?#194 5(NR)*; U?#195 3(~{ER}R) 5(NR)*; U?#196 5(NR)*; U?#197 5(NR)*; U?#198 5(NR)*; U?#199 5(NR)*; U?#200 5(NR)*; U?#201 5(NR)*; U?#202 5(NR)*; U?#203 3(~{ER}R) 5(NR)*; U?#204 5(NR)*; U?#205 3(~{ER}R) 5(NR)*; U?#206 5(NR)*; U?#207 3(~{ER}R) 5(NR)*; U?#208 5(NR)*; Y?#4 1(TRI_STATE)

## Layout directives
differential pair: D1_N, D1_P, D2_N, D3_N, D3_P, D4_N, D4_P, XAD-AD8_P, XADC-AD0_P, XADC-AD8_N
differential pair; differential pair class XAD0-AD0_N: XAD0-AD0_N
differential pair; differential pair class D1_P; differential pair class D1_N: D2_P

## Notes on the sheet
- analog I/O s
- ANALOG CURRENT AMPLIFIER
- DIGITAL CURRENT AMPLIFIER
- Labels drawn without touching a wire or pin: analog_out_21, analog_out_30, digital_out_20, digital_out_23, digital_out_90, digital_out_91, digital_out_92, digital_out_93, digital_out_94, digital_out_95, digital_out_96, digital_out_97, digital_out_98, digital_out_99, digital_out_100, out_a_8, out_a_24
- Title
- Size:
- Date:
- File:
- A0
- Number:
- Time:
- Revision:
- Sheet
- of
- (in symbol 1840772-8) YELLOW; GREEN
- (in symbol CMP-0363-00015-3, part A) BANK 13
- (in symbol CMP-0363-00015-3, part B) BANK 33
- (in symbol CMP-0363-00015-3, part C) BANK 34
- (in symbol CMP-0363-00015-3, part D) BANK 35
- (in symbol MAX232) TTL; RS232; T1; T2; R1; R2

## Library data of the parts
bank33 bank_13 bank_34 U?#2-U?#5 U?#7 = CMP-0363-00015-3: 667 MHz Zynq™-7000 AP SoC, 130 PS I/O, 200 FPGA I/O, 484-Ball BGA, Speed Grade 1, Industrial Grade, Pb-Free; Flip Flops: 106400; Speed Grade: -1; Extensible Block RAM (# 36Kb Blocks): 560 KB (140); LUTs: 53200; PartNumber: XC7Z020-1CLG484I; Generic Part Number: XC7Z020; ComponentLink6Description: PCB and Layout Guide; ComponentLink4Description: Package File; ComponentLink5Description: Packaging and Pinout; RoHS: Pb-Free; PackageDescription: Wire-Bond Chip-Scale BGA, Body 19 x 19 mm, 0.8 mm Pitch; ComponentLink4URL: http://www.xilinx.com/support/packagefiles/z7packages/xc7z020clg484pkg.txt; DatasheetVersion: v1.2; ComponentLink2URL: http://www.xilinx.com/support/documentation/user_guides/ug865-Zynq-7000-Pkg-Pinout.pdf; Mounting Technology: Surface Mount; ComponentLink6URL: http://www.xilinx.com/support/documentation/user_guides/ug483_7Series_PCB.pdf; ComponentLink5URL: http://www.xilinx.com/support/documentation/user_guides/ug865-Zynq-7000-Pkg-Pinout.pdf; ComponentLink3URL: http://www.xilinx.com/support/documentation/data_sheets/ds187-XC7Z010-XC7Z020-Data-Sheet.pdf; ComponentLink1Description: Datasheet; ComponentLink3Description: DC and AC Switching Characteristics; Code_JEDEC: MO-275-PPAA-2; PackageVersion: Rev 1.1, 09/2012; PackageReference: CLG484; ComponentLink1URL: http://www.xilinx.com/support/documentation/data_sheets/ds190-Zynq-7000-Overview.pdf; ComponentLink2Description: Package Specification
bank35 U?#1 = CMP-0363-00015-3: 667 MHz Zynq™-7000 AP SoC, 130 PS I/O, 200 FPGA I/O, 484-Ball BGA, Speed Grade 1, Industrial Grade, Pb-Free; PartNumber: XC7Z020-1CLG484I; Generic Part Number: XC7Z020; Flip Flops: 106400; Speed Grade: -1; Extensible Block RAM (# 36Kb Blocks): 560 KB (140); LUTs: 53200; ComponentLink6Description: PCB and Layout Guide; ComponentLink4Description: Package File; ComponentLink5Description: Packaging and Pinout; RoHS: Pb-Free; PackageDescription: Wire-Bond Chip-Scale BGA, Body 19 x 19 mm, 0.8 mm Pitch; ComponentLink4URL: http://www.xilinx.com/support/packagefiles/z7packages/xc7z020clg484pkg.txt; DatasheetVersion: v1.2; ComponentLink2URL: http://www.xilinx.com/support/documentation/user_guides/ug865-Zynq-7000-Pkg-Pinout.pdf; Mounting Technology: Surface Mount; ComponentLink6URL: http://www.xilinx.com/support/documentation/user_guides/ug483_7Series_PCB.pdf; ComponentLink5URL: http://www.xilinx.com/support/documentation/user_guides/ug865-Zynq-7000-Pkg-Pinout.pdf; ComponentLink3URL: http://www.xilinx.com/support/documentation/data_sheets/ds187-XC7Z010-XC7Z020-Data-Sheet.pdf; ComponentLink1Description: Datasheet; ComponentLink3Description: DC and AC Switching Characteristics; Code_JEDEC: MO-275-PPAA-2; PackageVersion: Rev 1.1, 09/2012; PackageReference: CLG484; ComponentLink1URL: http://www.xilinx.com/support/documentation/data_sheets/ds190-Zynq-7000-Overview.pdf; ComponentLink2Description: Package Specification
C1 C2 C?#66 C?#79 C?#110 C?#122 C?#152 C?#160 C?#165 C?#174-C?#235 = Cap: Capacitor; Published: 8-Jun-2000; LatestRevisionDate: 17-Jul-2002; LatestRevisionNote: Re-released for DXP Platform.; PackageReference: RAD-0.3; Publisher: Altium Limited
C?#1 C?#14 C?#15 C?#40 C?#41 C?#68-C?#70 C?#88 C?#104 C?#105 C?#123 C?#134-C?#136 C?#150 = T541X107M025AH6510: MF: {'manufacturer': u'KEMET'}; Package: None; Price: None; Value: *; MP: T541X107M025AH6510; Availability: Unavailable
C?#2-C?#4 C?#25-C?#30 C?#51-C?#53 C?#63-C?#65 C?#67 C?#80 C?#81 C?#94-C?#97 C?#111-C?#114 C?#128 C?#143-C?#145 C?#159 C?#167 = 08055C121KAT2A: Cap Ceramic 120pF 50V X7R 10% SMD 2.0 x 1.2 mm 125 C T/R; MF: {'manufacturer': u'AVX'}; Package: None; Price: None; Value: *; MP: 08055C121KAT2A; Availability: Unavailable
C?#5-C?#9 C?#20-C?#24 C?#31-C?#35 C?#46-C?#50 C?#56-C?#62 C?#82-C?#84 C?#89-C?#93 C?#98-C?#100 C?#115-C?#121 C?#126 C?#127 C?#140-C?#142 C?#146 C?#147 = 08055C473MAT2A: Cap Ceramic 0.047uF 50V X7R 20% SMD 0805 125Â°C Paper T/R; MF: {'manufacturer': u'AVX'}; Package: None; Price: None; Value: *; MP: 08055C473MAT2A; Availability: Unavailable
C?#10 C?#19 C?#36 C?#45 C?#76 C?#85 C?#101 C?#109 C?#125 C?#129 C?#130 C?#139 C?#148 = 08055C474JAT2A: SMCR .47M 0805 50V J X7R; MF: {'manufacturer': u'AVX'}; Package: None; Price: None; Value: *; MP: 08055C474JAT2A; Availability: Unavailable
C?#11-C?#13 C?#16-C?#18 C?#37-C?#39 C?#42-C?#44 C?#71-C?#75 C?#86 C?#87 C?#102 C?#103 C?#106-C?#108 C?#124 C?#131-C?#133 C?#137 C?#138 C?#149 = TCJR475M010S0500: 4.7UF 10V 20% ESR500 2012-12; MF: {'manufacturer': u'AVX'}; Package: None; Price: None; Value: *; MP: TCJR475M010S0500; Availability: Unavailable
C?#54 C?#55 C?#77 C?#78 = 08055C104KAT4A: .1UF 50V 10% 0805; MF: {'manufacturer': u'AVX'}; Package: None; Price: None; Value: *; MP: 08055C104KAT4A; Availability: Unavailable
C?#151 = GRM188R6YA106MA73D: SMD Capacitor X5R(EIA) with Capacitance: 10uF Tol. 20%. Rated Voltage: 35Vdc; MF: {'manufacturer': u'Murata'}; Package: None; Price: None; Value: *; MP: GRM188R6YA106MA73D; Availability: Unavailable
C?#153 C?#154 = GRM0335C1H390JA01D: Cap Ceramic 39pF 50V C0G 5% Pad SMD 0201 125C T/R; MF: {'manufacturer': u'Murata'}; Package: None; Price: None; Value: *; MP: GRM0335C1H390JA01D; Availability: Unavailable
C?#155-C?#158 C?#162-C?#164 C?#169-C?#173 = GRM188R71H104KA93D: CERAMIC CAPACITOR, 0.1UF, 50V, X7R, 10%, 0603, FULL REEL <a href="https://pricing.snapeda.com/parts/GRM188R71H104KA93D/Murata/view-part?ref=eda">Check availability</a>; MF: {'manufacturer': u'Murata'}; Package: None; Price: None; Value: *; MP: GRM188R71H104KA93D; Availability: Unavailable
C?#161 = GRM155R60J106ME15D: SMD Capacitor X5R(EIA) with Capacitance: 10uF Tol. 20%. Rated Voltage: 6.3Vdc; MF: {'manufacturer': u'Murata'}; Package: None; Price: None; Value: *; MP: GRM155R60J106ME15D; Availability: Unavailable
C?#166 = GCM188R71H104KA57J: Cap Ceramic 0.1uF 50V X7R 10% Pad SMD 0603 125C Automotive T/R; MF: {'manufacturer': u'Murata'}; Package: None; Price: None; Value: *; MP: GCM188R71H104KA57J; Availability: Unavailable
C?#168 = C0603KRX7R9BB102: 0603 1 nF 50 V Â±10 % Tolerance X7R Surface Mount Ceramic Capacitor; MF: {'manufacturer': u'Yageo'}; Package: None; Price: None; Value: *; MP: C0603KRX7R9BB102; Availability: Unavailable
D?#1-D?#4 = 1SMA5926: MF: {'manufacturer': u'Taiwan Semiconductor'}; Package: None; Price: None; Value: *; MP: 1SMA5926; Availability: Unavailable
D?#5 = 597-3305-607F: LED Uni-Color Green 4-Pin Chip 0805 T/R; MF: {'manufacturer': u'Dialight'}; Package: None; Price: None; Value: *; MP: 597-3305-607F; Availability: Unavailable
D?#6 = BAT20JFILM: 23V, 1A Schottky diode, SOD-323 package; MF: {'manufacturer': u'STMicroelectronics'}; Package: None; Price: None; Value: *; MP: BAT20JFILM; Availability: Unavailable
FL?#1-FL?#3 = NFZ32BW3R6HZ10L: Ferrite Bead 100 Ohm 2smd 1ln; MF: {'manufacturer': u'Murata'}; Package: None; Price: None; Value: *; MP: NFZ32BW3R6HZ10L; Availability: Unavailable
J1 J2 J?#9-J?#16 = D Connector 9: Receptacle Assembly, 9 Position, Right Angle; PackageDocument: O; Positions: 9; Published: 15-Jun-2001; LatestRevisionDate: 17-Jul-2002; LatestRevisionNote: Re-released for DXP Platform.; DatasheetDocument: 1-Sep-1999; PackageReference: 788750; Publisher: Altium Limited; Orientation: Right Angle; Gender: Receptacle
J?#1 = 1840772-8: 1X1 | 1000Base-T | Tab Up | G/Y | Press Fit | RoHS; MF: {'manufacturer': u'Bel Fuse'}; Package: None; Price: None; Value: *; MP: 1840772-8; Availability: Unavailable
J?#2-J?#5 J?#7 = 640445-3: MF: {'manufacturer': u'TE Connectivity'}; Package: None; Price: None; Value: *; MP: 640445-3; Availability: Unavailable
J?#6 = TSM-107-01-F-DV-A: MF: {'manufacturer': u'Samtec'}; Package: None; Price: None; Value: *; MP: TSM-107-01-F-DV-A; Availability: Unavailable
J?#8 = TSM-110-01-L-DV-TR: MF: {'manufacturer': u'Samtec'}; Package: None; Price: None; Value: *; MP: TSM-110-01-L-DV-TR; Availability: Unavailable
p1 P2 P3 p5 p?#2-p?#4 p?#6 p?#7 p?#9-p?#11 = Header 30: Header, 30-Pin; LatestRevisionDate: 17-Jul-2002; LatestRevisionNote: Re-released for DXP Platform.; Publisher: Altium Limited
P4 P?#1 P?#5 P?#8 = Header 10: Header, 10-Pin; LatestRevisionDate: 17-Jul-2002; LatestRevisionNote: Re-released for DXP Platform.; Publisher: Altium Limited
Q?#1-Q?#100 = MOSFET-N: N-Channel MOSFET; Published: 8-Jun-2000; LatestRevisionDate: 17-Jul-2002; LatestRevisionNote: Re-released for DXP Platform.; PackageVersion: 1995/1996; PackageReference: E3; Publisher: Altium Limited; PackageDescription: TO, Flat Index; 3 In-Line, Axial Leads; Body Dia. 4.6mm; Lead Dia. 0.5 mm (max)
R?#1-R?#131 R?#133-R?#139 R?#143 R?#144 R?#146-R?#156 R?#158 R?#159 R?#161-R?#163 R?#168 R?#170 R?#171 R?#173 R?#179-R?#197 R?#200-R?#208 R?#210-R?#218 R?#220-R?#225 R?#227-R?#229 R?#231 R?#233-R?#363 = Res: Resistor; Published: 8-Jun-2000; LatestRevisionDate: 17-Jul-2002; LatestRevisionNote: Re-released for DXP Platform.; PackageReference: AXIAL-0.3; Publisher: Altium Limited
R?#132 R?#199 = CRGCQ0805F10K: Fixed Resistor CRGCQ 0805 10K 1%; MF: {'manufacturer': u'TE Connectivity'}; Package: None; Price: None; Value: *; MP: CRGCQ0805F10K; Availability: Unavailable
R?#140 R?#219 = CRCW020124R0JNED: RES SMD 24 OHM 5% 1/20W 0201; MF: {'manufacturer': u'Vishay Dale'}; Package: None; Price: None; Value: *; MP: CRCW020124R0JNED; Availability: Unavailable
R?#141 R?#142 R?#145 R?#157 R?#165 R?#169 R?#177 = ERJU06J203V: MF: {'manufacturer': u'Panasonic'}; Package: None; Price: None; Value: *; MP: ERJU06J203V; Availability: Unavailable
R?#160 R?#164 R?#166 R?#230 R?#232 = ERJS06F1000V: MF: {'manufacturer': u'Panasonic'}; Package: None; Price: None; Value: *; MP: ERJS06F1000V; Availability: Unavailable
R?#167 = RCP2512W50R0JED: RES SMD 50 OHM 5% 3.5W 2512; MF: {'manufacturer': u'Vishay'}; Package: None; Price: None; Value: *; MP: RCP2512W50R0JED; Availability: Unavailable
R?#172 R?#174 = Res1: Resistor; Published: 8-Jun-2000; LatestRevisionDate: 17-Jul-2002; LatestRevisionNote: Re-released for DXP Platform.; PackageReference: AXIAL-0.3; Publisher: Altium Limited; PackageDescription: Axial Device, Thru-Hole; 2 Leads; 0.3 in Pin Spacing
R?#175 R?#226 = ERJPA3D4701V: MF: {'manufacturer': u'Panasonic'}; Package: None; Price: None; Value: *; MP: ERJPA3D4701V; Availability: Unavailable
R?#176 = ERJU1DF2700U: MF: {'manufacturer': u'Panasonic'}; Package: None; Price: None; Value: *; MP: ERJU1DF2700U; Availability: Unavailable
R?#178 R?#198 R?#209 = 2-2176070-5: 3521 100R 1% 2W; MF: {'manufacturer': u'TE Connectivity'}; Package: None; Price: None; Value: *; MP: 2-2176070-5; Availability: Unavailable
S1 S?#1 S?#3 = SW-PB: Switch; Published: 24-Mar-1999; LatestRevisionDate: 17-Jul-2002; LatestRevisionNote: Re-released for DXP Platform.; PackageReference: SPST-2; Publisher: Altium Limited
S?#2 S?#4 = FSM8JH: Switch, Pushbutton, Tactile, SPST, Thru Hole, Vertical, 6MM, Black; MF: {'manufacturer': u'TE Connectivity'}; Package: None; Price: None; Value: *; MP: FSM8JH; Availability: Unavailable
U1-U3 = STM32F103V8T6: STM32 ARM-based 32-bit MCU with 64 Kbytes Flash, 100-pin LQFP, Industrial Temperature; Published: 30-May-2008; DatasheetVersion: rev6, Mar-2008; PackageVersion: Mar-2008; PackageReference: LQFP100; Publisher: Altium Limited; PackageDescription: 100-Pin Low-Profile Quad Flat Pack, 14 x 14 mm Body, 0.5 mm Pitch (LQFP100); ComponentLink1Description: Manufacturer Link; ComponentLink1URL: www.st.com/stm32; ComponentLink2Description: Datasheet; ComponentLink2URL: http://www.st.com/stonline/products/literature/ds/13587.pdf
U4-U10 = AD5590BBCZ: 16 Input/16 Output Analog I/O Port With Integrated Amplifiers; MF: Analog Devices; SnapEDA_Link: https://www.snapeda.com/parts/AD5590BBCZ/Analog+Devices/view-part/?ref=snap; Package: CSPBGA -80 Analog Devices; Value: *; MP: AD5590BBCZ; Check_prices: https://www.snapeda.com/parts/AD5590BBCZ/Analog+Devices/view-part/?ref=eda
U11-U15 = MAX232: +5V Powered, Multi-Channel RS-232 Driver/Receiver; ComponentAuthor: Saeid Jorablo; ComponentLink1Description: Datasheet; ComponentLink1URL: http://pdfserv.maxim-ic.com/en/ds/MAX220-MAX249.pdf
U?#6 = 88E1518-A0-NNB2C000: MF: {'manufacturer': u'Marvell'}; Package: None; Price: None; Value: *; MP: 88E1518-A0-NNB2C000; Availability: Unavailable
U?#8 = CMP-12948-000008-1: IC FLASH 256M SPI 133MHZ 8WSON; Manufacturer: Cypress Semiconductor; Memory Size: 256Mbits; Standoff Height: 0mm; Nominal Supply Current: 10-40mA; Memory Type: FLASH,NOR; Max Supply Voltage: 3.6V; Min Supply Voltage: 2.7V; Access Time: 8ns; Ambient Temperature Range High: +105°C; Ipc Land Pattern Name: DFN600X800X75-8; RoHS: TRUE; Temperature Range Low: -40°C; Device Class L2: Memory; Device Class L1: Integrated Circuits (ICs); Height: 0.8mm; Temperature: -40°C to +105°C; ComponentLink2Description: Datasheet; Device Class L3: Flash; Octopart: https://octopart.com/s25fl256lagnfv010-cypress+semiconductor-82336478; Frequency: 133MHz; ComponentLink2URL: https://www.cypress.com/file/316171/download; Category: IC; Lead Free: Yes; Manufacturer Part Number: S25FL256LAGNFV010; Digikey Description: IC FLASH 256M SPI 133MHZ 8WSON; Temperature Range High: +105°C; Ambient Temperature Range Low: -40°C; Footprint Url: https://www.cypress.com/file/217366/download; Mouser Description: NOR Flash Serial-SPI 3V/3.3V 256M-bit 256M/128M/64M x 1/2-bit/4-bit 8ns 8-Pin WSON EP Tray; Package: 002-18827; Automotive: No; Interface: SPI
U?#9-U?#208 = ADP3330: High Accuracy Ultralow IQ,  200 mA, SOT-23, anyCAP? Low Dropout Regulator
Y1 Y?#1 Y?#3 = XTAL: Crystal Oscillator; Published: 8-Jun-2000; LatestRevisionDate: 17-Jul-2002; LatestRevisionNote: Re-released for DXP Platform.; PackageReference: R38; Publisher: Altium Limited
Y?#2 = XRCGB25M000F3M04R0: 27MHz Â±20ppm Crystal 6pF 150 Ohms 4-SMD, No Lead; MF: {'manufacturer': u'Murata'}; Package: None; Price: None; Value: *; MP: XRCGB25M000F3M04R0; Availability: Unavailable
Y?#4 = ECS-2520MV-333.3-BN-TR: MF: {'manufacturer': u'ECS Inc.'}; Package: None; Price: None; Value: *; MP: ECS-2520MV-333.3-BN-TR; Availability: Unavailable